# EasyEDA Pro project kuafu01_030内部老化方案.eprj, board PCB4 (continued)
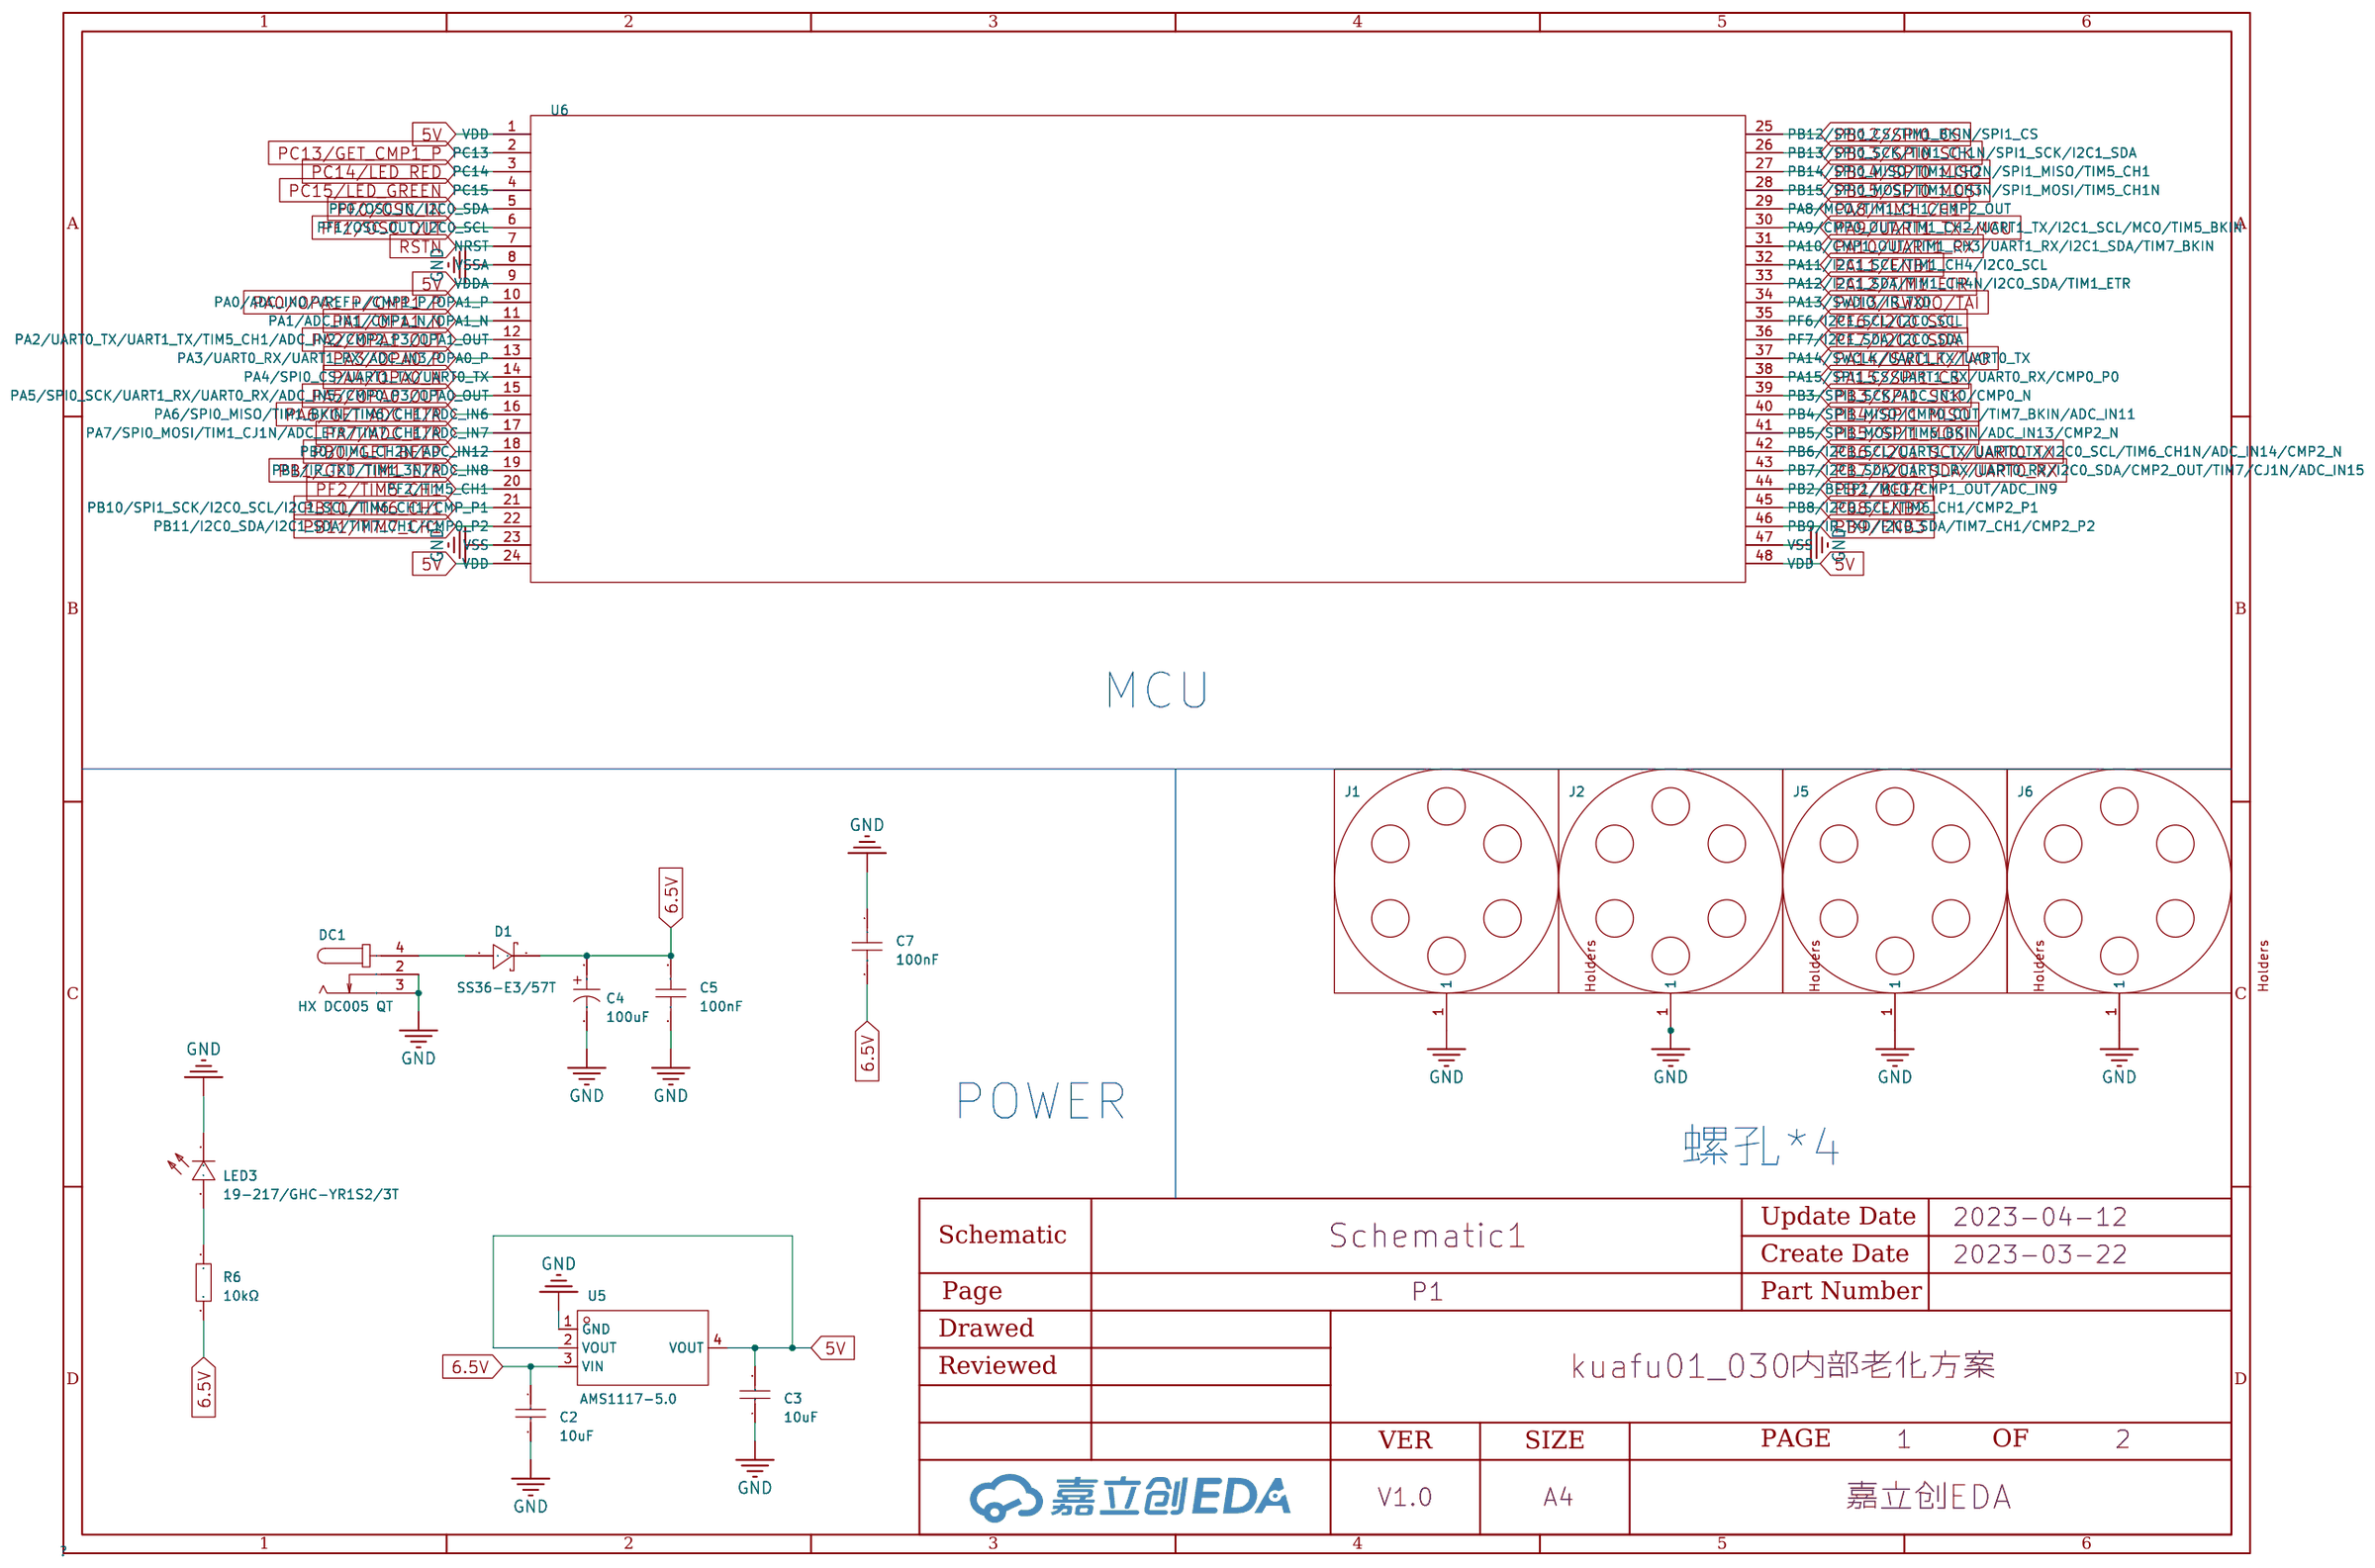
[diagram p0: P1]
## Routing (per net, layer and track width the routed paths; a pad name or vN(x,y) marks a point on that pad's centre or on a via; arc(x,y) is an arc through that point) (continued)
  Top Layer w0.508: 200.44,161.61 200.41,161.58 v1(200.41,157.57) ; 200.44,161.61 149.57,161.61 ; 200.44,161.61 251.35,161.61 ; 236.94,339.07 236.94,339.07 v1(236.94,334.16) ; v1(43.43,270.81) 44.29,271.67 44.29,272.14 ; 149.57,161.61 98.97,161.61 ; 149.57,161.61 149.61,161.57 v1(149.61,157.57) ; 45.29,164.02 44.29,164.02 v1(41.25,167.06) ; 45.29,164.02 v1(47.58,164.02) ; 45.29,164.02 48.16,166.9 48.16,167.38 ; v1(153.07,114.69) 154.26,114.69 156.79,117.22 v1(156.79,118.95) ; 98.97,161.61 48.02,161.61 ; 98.97,161.61 98.81,161.45 v1(98.81,157.57) ; v1(139.01,173.28) 139.01,171.89 ; 139.01,171.89 139.02,171.89 140.14,171.89 ; 139.01,171.89 139.01,166.75 139.72,166.04 140.27,166.04 140.34,166.12 140.34,166.03 v1(140.35,166.01) ; v1(48.01,106.77) 44.55,110.24 34.04,110.24 21.34,122.94 21.34,161.61 ; 299.29,265.62 302.16,268.5 302.16,268.98 ; 299.29,265.62 v1(301.58,265.62) ; 299.29,265.62 298.29,265.62 v1(295.25,268.66) ; 200.12,252.96 195.17,248.01 v1(195.17,239.32) ; v1(145.03,321.61) 145.89,322.47 145.89,322.94 ; 292.54,222.69 291.42,222.69 291.41,222.69 ; 48.01,59.27 v1(48.01,55.97) ; 48.18,313.94 60.96,313.94 64.89,317.88 C3#4.2 64.86,323.25 U5#3.4 ; 48.18,313.94 34.54,313.94 24.38,303.78 24.38,263.17 ; 48.18,313.94 48.01,313.78 v1(48.01,309.97) ; v1(135.34,80.16) 135.34,85.07 135.34,85.07 ; 98.83,366.27 149.6,366.27 ; 98.83,366.27 98.81,366.26 v1(98.81,360.77) ; 98.83,366.27 88.9,366.27 83.82,361.19 83.82,356.01 C3#3.2 ; 149.6,366.27 200.34,366.27 ; 149.6,366.27 149.61,366.26 v1(149.61,360.77) ; 146.89,11.62 145.89,11.62 v1(142.85,14.66) ; 146.89,11.62 v1(149.18,11.62) ; 146.89,11.62 149.76,14.5 149.76,14.98 ; v1(162.06,74.16) 162.06,73.16 162.27,72.96 162.27,70.83 161.73,70.3 157.54,70.3 v1(156.8,71.04) ; 139.01,19.49 139.01,14.35 139.72,13.64 140.27,13.64 140.34,13.72 140.34,13.63 v1(140.35,13.61) ; 139.01,19.49 v1(139.01,20.88) ; 139.01,19.49 139.02,19.49 140.14,19.49 ; v1(200.37,306.12) 200.37,303.86 200.29,303.78 ; 299.29,113.22 302.16,116.1 302.16,116.58 ; 299.29,113.22 298.29,113.22 v1(295.25,116.26) ; 299.29,113.22 v1(301.58,113.22) ; 95.09,18.14 95.09,17.67 v1(94.23,16.81) ; 197.69,316.42 196.69,316.42 v1(193.65,319.46) ; 197.69,316.42 v1(199.98,316.42) ; 197.69,316.42 200.56,319.3 200.56,319.78 ; 45.29,11.62 44.29,11.62 v1(41.25,14.66) ; 45.29,11.62 48.16,14.5 48.16,14.98 ; 45.29,11.62 v1(47.58,11.62) ; v1(55.19,68.15) 55.19,66.42 52.66,63.89 v1(51.47,63.89) ; 197.69,164.02 196.69,164.02 v1(193.65,167.06) ; 197.69,164.02 200.56,166.9 200.56,167.38 ; 197.69,164.02 v1(199.98,164.02) ; 248.49,11.62 251.36,14.5 251.36,14.98 ; 248.49,11.62 247.49,11.62 v1(244.45,14.66) ; 248.49,11.62 v1(250.78,11.62) ; v1(305.47,114.69) 306.66,114.69 309.19,117.22 v1(309.19,118.95) ; 96.09,265.62 98.96,268.5 98.96,268.98 ; 96.09,265.62 95.09,265.62 v1(92.05,268.66) ; 96.09,265.62 v1(98.38,265.62) ; v1(200.41,208.37) 203.88,211.84 251.13,211.84 ; v1(251.21,106.77) 251.21,110.15 251.13,110.24 ; v1(55.2,223.44) 55.94,222.7 60.13,222.7 60.67,223.23 60.67,225.36 60.46,225.56 v1(60.46,226.56) ; v1(105.99,68.15) 105.99,66.42 103.46,63.89 v1(102.27,63.89) ; v1(251.17,356.92) 251.17,354.66 251.09,354.58 ; 190.94,121.09 189.82,121.09 189.81,121.09 ; 44.29,119.74 44.29,119.27 v1(43.43,118.41) ; 186.14,85.07 186.14,85.07 v1(186.14,80.16) ; 88.21,171.89 88.22,171.89 89.34,171.89 ; 88.21,171.89 v1(88.21,173.28) ; 88.21,171.89 88.21,166.75 88.92,166.04 89.47,166.04 89.54,166.12 89.54,166.03 v1(89.55,166.01) ; v1(153.07,63.89) 154.26,63.89 156.79,66.42 v1(156.79,68.15) ; v1(43.43,169.21) 44.29,170.07 44.29,170.54 ; v1(51.47,13.09) 52.66,13.09 55.19,15.62 v1(55.19,17.35) ; 98.52,151.36 93.57,146.41 v1(93.57,137.72) ; v1(47.97,255.32) 47.97,253.06 47.89,252.98 ; 250.92,252.96 245.97,248.01 v1(245.97,239.32) ; 248.49,316.42 251.36,319.3 251.36,319.78 ; 248.49,316.42 247.49,316.42 v1(244.45,319.46) ; 248.49,316.42 v1(250.78,316.42) ; 96.09,214.82 v1(98.38,214.82) ; 96.09,214.82 98.96,217.7 98.96,218.18 ; 96.09,214.82 95.09,214.82 v1(92.05,217.86) ; v1(241.95,115.21) 241.94,115.23 241.94,115.32 241.87,115.24 241.32,115.24 240.61,115.95 240.61,121.09 ; v1(297.43,270.81) 298.29,271.67 298.29,272.14 ; v1(111.26,277.36) 111.26,276.36 111.47,276.16 111.47,274.03 110.93,273.5 106.74,273.5 v1(106,274.24) ; v1(98.81,55.97) 98.81,59.29 ; 298.29,170.54 298.29,170.07 v1(297.43,169.21) ; 250.92,202.16 245.97,197.21 v1(245.97,188.52) ; v1(139.01,274.88) 139.01,273.49 ; 139.01,273.49 139.02,273.49 140.14,273.49 ; 139.01,273.49 139.01,268.36 139.72,267.64 140.27,267.64 140.34,267.72 140.34,267.63 v1(140.35,267.61) ; 146.89,113.22 145.89,113.22 v1(142.85,116.26) ; 146.89,113.22 149.76,116.1 149.76,116.58 ; 146.89,113.22 v1(149.18,113.22) ; v1(251.21,55.97) 251.21,59.43 251.21,59.44 ; 189.81,171.89 189.82,171.89 190.94,171.89 ; 189.81,171.89 189.81,166.75 190.52,166.04 191.07,166.04 191.14,166.12 191.14,166.03 v1(191.15,166.01) ; 189.81,171.89 v1(189.81,173.28) ; v1(191.15,267.61) 191.14,267.63 191.14,267.72 191.07,267.64 190.52,267.64 189.81,268.36 189.81,273.49 ; 88.21,273.49 88.21,268.36 88.92,267.64 89.47,267.64 89.54,267.72 89.54,267.63 v1(89.55,267.61) ; 88.21,273.49 v1(88.21,274.88) ; 88.21,273.49 88.22,273.49 89.34,273.49 ; v1(162.06,226.56) 162.06,225.56 162.27,225.36 162.27,223.23 161.73,222.7 157.54,222.7 v1(156.8,223.44) ; 302.05,313.94 251.27,313.94 ; 302.05,313.94 333.25,313.94 336.8,317.5 336.8,349.5 320.04,366.27 301.89,366.27 ; 302.05,313.94 302.01,313.91 v1(302.01,309.97) ; 251.27,313.94 200.24,313.94 ; 251.27,313.94 251.21,313.89 v1(251.21,309.97) ; 149.71,110.24 102.28,110.24 v1(98.81,106.77) ; 149.71,110.24 200.48,110.24 ; 149.71,110.24 149.61,110.14 v1(149.61,106.77) ; v1(302.01,157.57) 302.01,161.52 302.11,161.61 ; v1(105.99,220.55) 105.99,218.82 103.46,216.29 v1(102.27,216.29) ; v1(162.06,277.36) 162.06,276.36 162.27,276.16 162.27,274.03 161.73,273.5 157.54,273.5 v1(156.8,274.24) ; 146.89,164.02 v1(149.18,164.02) ; 146.89,164.02 149.76,166.9 149.76,167.38 ; 146.89,164.02 145.89,164.02 v1(142.85,167.06) ; 241.74,324.29 240.62,324.29 240.61,324.29 ; 240.61,19.49 240.62,19.49 241.74,19.49 ; 240.61,19.49 240.61,14.35 241.32,13.64 241.87,13.64 241.94,13.72 241.94,13.63 v1(241.95,13.61) ; 240.61,19.49 v1(240.61,20.88) ; v1(42.77,188.52) 42.77,197.21 47.72,202.16 ; 292.54,171.89 291.42,171.89 291.41,171.89 ; 135.34,34.27 135.34,34.27 v1(135.34,29.36) ; 64.89,328 64.86,328.02 U5#3.2 ; v1(111.26,23.36) 111.26,22.36 111.47,22.16 111.47,20.03 110.93,19.5 106.74,19.5 v1(106,20.24) ; 88.21,222.69 88.21,217.56 88.92,216.84 89.47,216.84 89.54,216.92 89.54,216.83 v1(89.55,216.81) ; 88.21,222.69 v1(88.21,224.08) ; 88.21,222.69 88.22,222.69 89.34,222.69 ; 96.09,62.42 98.96,65.3 98.96,65.78 ; 96.09,62.42 95.09,62.42 v1(92.05,65.46) ; 96.09,62.42 v1(98.38,62.42) ; 149.76,319.78 149.76,319.3 146.89,316.42 ; 146.89,265.62 145.89,265.62 v1(142.85,268.66) ; 146.89,265.62 v1(149.18,265.62) ; 146.89,265.62 149.76,268.5 149.76,268.98 ; 197.69,11.62 v1(199.98,11.62) ; 197.69,11.62 196.69,11.62 v1(193.65,14.66) ; 197.69,11.62 200.56,14.5 200.56,14.98 ; v1(251.21,208.37) 251.21,211.75 251.13,211.84 ; 248.49,62.42 251.36,65.3 251.36,65.78 ; 248.49,62.42 v1(250.78,62.42) ; 248.49,62.42 247.49,62.42 v1(244.45,65.46) ; 48.16,218.18 48.16,217.7 45.29,214.82 ; v1(296.77,188.52) 296.77,197.21 301.72,202.16 ; 240.61,70.29 240.61,65.16 241.32,64.44 241.87,64.44 241.94,64.52 241.94,64.43 v1(241.95,64.41) ; 240.61,70.29 v1(240.61,71.68) ; 240.61,70.29 240.62,70.29 241.74,70.29 ; v1(292.75,216.81) 292.74,216.83 292.74,216.92 292.67,216.84 292.12,216.84 291.41,217.56 291.41,222.69 ; 48.08,212.34 33.53,212.34 24.38,221.49 24.38,263.17 ; 48.08,212.34 99.01,212.34 ; 48.08,212.34 48.01,212.28 v1(48.01,208.37) ; 24.38,263.17 48.02,263.17 ; 84.54,186.67 84.54,186.67 v1(84.54,181.76) ; 38.54,19.49 37.42,19.49 37.41,19.49 ; 197.69,113.22 200.56,116.1 200.56,116.58 ; 197.69,113.22 v1(199.98,113.22) ; 197.69,113.22 196.69,113.22 v1(193.65,116.26) ; 302.11,161.61 324.68,161.61 336.8,173.74 336.8,206.76 331.72,211.84 301.91,211.84 ; 302.11,161.61 251.35,161.61 ; v1(200.37,52.12) 200.37,49.86 200.29,49.78 ; v1(37.41,71.68) 37.41,70.29 ; 37.41,70.29 37.42,70.29 38.54,70.29 ; 37.41,70.29 37.41,65.16 38.12,64.44 38.67,64.44 38.74,64.52 38.74,64.43 v1(38.75,64.41) ; 291.41,121.09 291.42,121.09 292.54,121.09 ; 291.41,121.09 v1(291.41,122.48) ; 291.41,121.09 291.41,115.95 292.12,115.24 292.67,115.24 292.74,115.32 292.74,115.23 v1(292.75,115.21) ; v1(258.39,220.55) 258.39,218.82 255.86,216.29 v1(254.67,216.29) ; 98.69,100.58 98.77,100.66 v1(98.77,102.92) ; 98.52,49.76 93.57,44.81 v1(93.57,36.12) ; v1(296.77,290.12) 296.77,298.81 301.72,303.76 ; v1(287.74,232.56) 287.74,237.47 287.74,237.47 ; 149.32,151.36 144.37,146.41 v1(144.37,137.72) ; 139.01,324.29 139.01,319.15 139.72,318.44 140.27,318.44 140.34,318.52 140.34,318.43 v1(140.35,318.41) ; 139.01,324.29 v1(139.01,325.68) ; 139.01,324.29 139.02,324.29 140.14,324.29 ; 299.29,316.42 v1(301.58,316.42) ; 299.29,316.42 302.16,319.3 302.16,319.78 ; 299.29,316.42 298.29,316.42 v1(295.25,319.46) ; 200.56,218.18 200.56,217.7 197.69,214.82 ; 47.89,100.58 47.97,100.66 v1(47.97,102.92) ; 200.24,313.94 149.74,313.94 ; 200.24,313.94 200.41,313.77 v1(200.41,309.97) ; 149.74,313.94 149.61,313.82 v1(149.61,309.97) ; 149.74,313.94 102.79,313.94 v1(98.81,309.97) ; 248.49,265.62 251.36,268.5 251.36,268.98 ; 248.49,265.62 247.49,265.62 v1(244.45,268.66) ; 248.49,265.62 v1(250.78,265.62) ; 33.74,186.67 33.74,186.67 v1(33.74,181.76) ; 145.89,170.54 145.89,170.07 v1(145.03,169.21) ; 189.81,222.69 189.82,222.69 190.94,222.69 ; 189.81,222.69 v1(189.81,224.08) ; 189.81,222.69 189.81,217.56 190.52,216.84 191.07,216.84 191.14,216.92 191.14,216.83 v1(191.15,216.81) ; v1(111.26,175.76) 111.26,174.76 111.47,174.56 111.47,172.43 110.93,171.9 106.74,171.9 v1(106,172.64) ; 200.29,100.58 200.37,100.66 v1(200.37,102.92) ; 37.41,171.89 37.41,166.75 38.12,166.04 38.67,166.04 38.74,166.12 38.74,166.03 v1(38.75,166.01) ; 37.41,171.89 37.42,171.89 38.54,171.89 ; 37.41,171.89 v1(37.41,173.28) ; 291.41,324.29 291.41,319.15 292.12,318.44 292.67,318.44 292.74,318.52 292.74,318.43 v1(292.75,318.41) ; 291.41,324.29 291.42,324.29 292.54,324.29 ; 291.41,324.29 v1(291.41,325.68) ; v1(149.57,204.52) 149.57,202.26 149.49,202.18 ; v1(305.47,267.09) 306.66,267.09 309.19,269.62 v1(309.19,271.35) ; 149.76,65.78 149.76,65.3 146.89,62.42 ; 21.34,161.61 48.02,161.61 ; 21.34,161.61 21.34,304.29 33.02,315.98 49.14,315.98 U5.4 U5.2 ; 48.02,161.61 48.01,161.6 v1(48.01,157.57) ; 89.34,324.29 88.22,324.29 88.21,324.29 ; 200.56,65.78 200.56,65.3 197.69,62.42 ; 287.74,288.27 287.74,288.27 v1(287.74,283.36) ; 45.29,265.62 v1(47.58,265.62) ; 45.29,265.62 44.29,265.62 v1(41.25,268.66) ; 45.29,265.62 48.16,268.5 48.16,268.98 ; 251.36,218.18 251.36,217.7 248.49,214.82 ; v1(297.43,67.61) 298.29,68.47 298.29,68.94 ; v1(60.46,74.16) 60.46,73.16 60.67,72.96 60.67,70.83 60.13,70.3 55.94,70.3 v1(55.2,71.04) ; v1(212.86,328.16) 212.86,327.16 213.07,326.96 213.07,324.83 212.53,324.3 208.34,324.3 v1(207.6,325.04) ; 197.69,62.42 v1(199.98,62.42) ; 197.69,62.42 196.69,62.42 v1(193.65,65.46) ; v1(189.81,122.48) 189.81,121.09 ; 189.81,121.09 189.81,115.95 190.52,115.24 191.07,115.24 191.14,115.32 191.14,115.23 v1(191.15,115.21) ; 186.14,135.87 186.14,135.87 v1(186.14,130.96) ; 301.89,366.27 302.01,366.15 v1(302.01,360.77) ; 301.89,366.27 200.34,366.27 ; 149.76,218.18 149.76,217.7 146.89,214.82 ; v1(212.86,175.76) 212.86,174.76 213.07,174.56 213.07,172.43 212.53,171.9 208.34,171.9 v1(207.6,172.64) ; v1(162.06,124.96) 162.06,123.96 162.27,123.76 162.27,121.63 161.73,121.1 157.54,121.1 v1(156.8,121.84) ; 291.41,222.69 v1(291.41,224.08) ; 45.29,62.42 44.29,62.42 v1(41.25,65.46) ; 45.29,62.42 48.16,65.3 48.16,65.78 ; 45.29,62.42 v1(47.58,62.42) ; 251.12,263.17 298.02,263.17 v1(302.01,259.17) ; 251.12,263.17 251.21,263.08 v1(251.21,259.17) ; 251.12,263.17 200.45,263.17 ; 240.61,273.49 240.61,268.36 241.32,267.64 241.87,267.64 241.94,267.72 241.94,267.63 v1(241.95,267.61) ; 240.61,273.49 v1(240.61,274.88) ; 240.61,273.49 240.62,273.49 241.74,273.49 ; 189.81,324.29 189.82,324.29 190.94,324.29 ; 189.81,324.29 189.81,319.15 190.52,318.44 191.07,318.44 191.14,318.52 191.14,318.43 v1(191.15,318.41) ; 189.81,324.29 v1(189.81,325.68) ; v1(111.26,124.96) 111.26,123.96 111.47,123.76 111.47,121.63 110.93,121.1 106.74,121.1 v1(106,121.84) ; v1(51.47,165.49) 52.66,165.49 55.19,168.02 v1(55.19,169.75) ; v1(156.8,20.24) 157.54,19.5 161.73,19.5 162.27,20.03 162.27,22.16 162.06,22.36 v1(162.06,23.36) ; v1(135.34,283.36) 135.34,288.27 135.34,288.27 ; v1(302.01,106.77) 302.01,110.22 302.03,110.24 ; 301.72,354.56 296.77,349.61 v1(296.77,340.92) ; 37.41,222.69 37.41,217.56 38.12,216.84 38.67,216.84 38.74,216.92 38.74,216.83 v1(38.75,216.81) ; 37.41,222.69 37.42,222.69 38.54,222.69 ; 37.41,222.69 v1(37.41,224.08) ; v1(37.41,274.88) 37.41,273.49 ; 37.41,273.49 37.42,273.49 38.54,273.49 ; 37.41,273.49 37.41,268.36 38.12,267.64 38.67,267.64 38.74,267.72 38.74,267.63 v1(38.75,267.61) ; 248.49,214.82 v1(250.78,214.82) ; 248.49,214.82 247.49,214.82 v1(244.45,217.86) ; v1(55.2,274.24) 55.94,273.5 60.13,273.5 60.67,274.03 60.67,276.16 60.46,276.36 v1(60.46,277.36) ; 135.34,339.07 135.34,339.07 v1(135.34,334.16) ; 145.89,68.94 145.89,68.47 v1(145.03,67.61) ; v1(254.67,317.89) 255.86,317.89 258.39,320.42 v1(258.39,322.15) ; v1(296.77,86.92) 296.77,95.61 301.72,100.56 ; 291.41,70.29 291.41,65.16 292.12,64.44 292.67,64.44 292.74,64.52 292.74,64.43 v1(292.75,64.41) ; 291.41,70.29 291.42,70.29 292.54,70.29 ; 291.41,70.29 v1(291.41,71.68) ; v1(309.19,68.15) 309.19,66.42 306.66,63.89 v1(305.47,63.89) ; v1(149.61,55.97) 149.61,59.29 149.75,59.44 ; v1(41.25,217.86) 44.29,214.82 45.29,214.82 ; 84.54,135.87 84.54,135.87 v1(84.54,130.96) ; v1(156.8,172.64) 157.54,171.9 161.73,171.9 162.27,172.43 162.27,174.56 162.06,174.76 v1(162.06,175.76) ; 135.34,186.67 135.34,186.67 v1(135.34,181.76) ; v1(195.83,321.61) 196.69,322.47 196.69,322.94 ; 48.02,263.17 48.01,263.16 v1(48.01,259.17) ; 48.02,263.17 149.62,263.17 ; v1(149.57,255.32) 149.57,253.06 149.49,252.98 ; 251.35,161.61 251.21,161.48 v1(251.21,157.57) ; v1(195.17,340.92) 195.17,349.61 200.12,354.56 ; 37.41,121.09 37.41,115.95 38.12,115.24 38.67,115.24 38.74,115.32 38.74,115.23 v1(38.75,115.21) ; 37.41,121.09 37.42,121.09 38.54,121.09 ; 37.41,121.09 v1(37.41,122.48) ; v1(212.86,124.96) 212.86,123.96 213.07,123.76 213.07,121.63 212.53,121.1 208.34,121.1 v1(207.6,121.84) ; 33.74,85.07 33.74,85.07 v1(33.74,80.16) ; 88.21,19.49 88.21,14.35 88.92,13.64 89.47,13.64 89.54,13.72 89.54,13.63 v1(89.55,13.61) ; 88.21,19.49 v1(88.21,20.88) ; 88.21,19.49 88.22,19.49 89.34,19.49 ; v1(245.97,36.12) 245.97,44.81 250.92,49.76 ; v1(42.77,137.72) 42.77,146.41 47.72,151.36 ; v1(142.85,217.86) 145.89,214.82 146.89,214.82 ; v1(92.05,319.46) 95.09,316.42 96.09,316.42 ; 248.49,164.02 v1(250.78,164.02) ; 248.49,164.02 247.49,164.02 v1(244.45,167.06) ; 248.49,164.02 251.36,166.9 251.36,167.38 ; 247.49,221.34 247.49,220.87 v1(246.63,220.01) ; v1(207.6,274.24) 208.34,273.5 212.53,273.5 213.07,274.03 213.07,276.16 212.86,276.36 v1(212.86,277.36) ; 146.89,62.42 145.89,62.42 v1(142.85,65.46) ; 146.89,62.42 v1(149.18,62.42) ; 200.34,366.27 200.41,366.2 v1(200.41,360.77) ; 200.12,151.36 195.17,146.41 v1(195.17,137.72) ; v1(263.66,175.76) 263.66,174.76 263.87,174.56 263.87,172.43 263.33,171.9 259.14,171.9 v1(258.4,172.64) ; 299.29,214.82 302.16,217.7 302.16,218.18 ; 299.29,214.82 v1(301.58,214.82) ; 299.29,214.82 298.29,214.82 v1(295.25,217.86) ; 37.41,19.49 37.41,14.35 38.12,13.64 38.67,13.64 38.74,13.72 38.74,13.63 v1(38.75,13.61) ; 37.41,19.49 v1(37.41,20.88) ; v1(309.2,325.04) 309.94,324.3 314.13,324.3 314.67,324.83 314.67,326.96 314.46,327.16 v1(314.46,328.16) ; 146.89,214.82 v1(149.18,214.82) ; 189.81,273.49 189.82,273.49 190.94,273.49 ; 189.81,273.49 v1(189.81,274.88) ; v1(314.46,175.76) 314.46,174.76 314.67,174.56 314.67,172.43 314.13,171.9 309.94,171.9 v1(309.2,172.64) ; 301.72,151.36 296.77,146.41 v1(296.77,137.72) ; 301.89,252.98 301.97,253.06 v1(301.97,255.32) ; 301.72,252.96 296.77,248.01 v1(296.77,239.32) ; 247.49,18.14 247.49,17.67 v1(246.63,16.81) ; v1(106,71.04) 106.74,70.3 110.93,70.3 111.47,70.83 111.47,72.96 111.26,73.16 v1(111.26,74.16) ; v1(186.14,283.36) 186.14,288.27 186.14,288.27 ; v1(195.17,188.52) 195.17,197.21 200.12,202.16 ; v1(236.94,29.36) 236.94,34.27 236.94,34.27 ; v1(245.97,290.12) 245.97,298.81 250.92,303.76 ; v1(207.59,118.95) 207.59,117.22 205.06,114.69 v1(203.87,114.69) ; v1(292.75,166.01) 292.74,166.03 292.74,166.12 292.67,166.04 292.12,166.04 291.41,166.75 291.41,171.89 ; v1(89.55,115.21) 89.54,115.23 89.54,115.32 89.47,115.24 88.92,115.24 88.21,115.95 88.21,121.09 ; 47.89,202.18 47.97,202.26 v1(47.97,204.52) ; v1(47.97,306.12) 47.97,303.86 47.89,303.78 ; 298.29,119.74 298.29,119.27 v1(297.43,118.41) ; 251.21,59.44 200.39,59.44 ; 251.21,59.44 328.17,59.44 336.8,68.07 336.8,106.17 332.74,110.24 302.03,110.24 ; v1(258.4,325.04) 259.14,324.3 263.33,324.3 263.87,324.83 263.87,326.96 263.66,327.16 v1(263.66,328.16) ; v1(200.41,106.77) 200.41,110.16 200.48,110.24 ; v1(258.39,271.35) 258.39,269.62 255.86,267.09 v1(254.67,267.09) ; 98.69,303.78 98.77,303.86 v1(98.77,306.12) ; v1(145.03,270.81) 145.89,271.67 145.89,272.14 ; 189.81,70.29 189.82,70.29 190.94,70.29 ; 189.81,70.29 189.81,65.16 190.52,64.44 191.07,64.44 191.14,64.52 191.14,64.43 v1(191.15,64.41) ; 189.81,70.29 v1(189.81,71.68) ; 149.32,49.76 144.37,44.81 v1(144.37,36.12) ; 240.61,171.89 240.62,171.89 241.74,171.89 ; 240.61,171.89 v1(240.61,173.28) ; 240.61,171.89 240.61,166.75 241.32,166.04 241.87,166.04 241.94,166.12 241.94,166.03 v1(241.95,166.01) ; 33.74,34.27 33.74,34.27 v1(33.74,29.36) ; 149.75,59.44 20.32,59.44 18.8,60.96 18.8,308.96 C3.2 33.52,323.92 U5#4.4 U5#4.2 ; 149.75,59.44 200.39,59.44 ; v1(301.97,306.12) 301.97,303.86 301.89,303.78 ; v1(207.59,271.35) 207.59,269.62 205.06,267.09 v1(203.87,267.09) ; 251.09,100.58 251.17,100.66 v1(251.17,102.92) ; v1(94.23,321.61) 95.09,322.47 95.09,322.94 ; 241.74,222.69 240.62,222.69 240.61,222.69 ; 140.14,121.09 139.02,121.09 139.01,121.09 ; 200.29,252.98 200.37,253.06 v1(200.37,255.32) ; 200.12,100.56 195.17,95.61 v1(195.17,86.92) ; v1(93.57,290.12) 93.57,298.81 98.52,303.76 ; v1(149.61,259.17) 149.61,263.16 149.62,263.17 ; 95.09,272.14 95.09,271.67 v1(94.23,270.81) ; v1(89.55,318.41) 89.54,318.43 89.54,318.52 89.47,318.44 88.92,318.44 88.21,319.15 88.21,324.29 ; v1(207.59,220.55) 207.59,218.82 205.06,216.29 v1(203.87,216.29) ; 247.49,119.74 247.49,119.27 v1(246.63,118.41) ; 248.49,113.22 v1(250.78,113.22) ; 248.49,113.22 247.49,113.22 v1(244.45,116.26) ; 248.49,113.22 251.36,116.1 251.36,116.58 ; 96.09,316.42 98.96,319.3 98.96,319.78 ; 96.09,316.42 v1(98.38,316.42) ; 140.14,222.69 139.02,222.69 139.01,222.69 ; v1(287.74,334.16) 287.74,339.07 287.74,339.07 ; v1(106,223.44) 106.74,222.7 110.93,222.7 111.47,223.23 111.47,225.36 111.26,225.56 v1(111.26,226.56) ; 99.01,212.34 98.81,212.15 v1(98.81,208.37) ; 99.01,212.34 145.64,212.34 v1(149.61,208.37) ; 84.54,85.07 84.54,85.07 v1(84.54,80.16) ; v1(246.63,169.21) 247.49,170.07 247.49,170.54 ; v1(207.6,20.24) 208.34,19.5 212.53,19.5 213.07,20.03 213.07,22.16 212.86,22.36 v1(212.86,23.36) ; v1(245.97,86.92) 245.97,95.61 250.92,100.56 ; v1(263.66,124.96) 263.66,123.96 263.87,123.76 263.87,121.63 263.33,121.1 259.14,121.1 v1(258.4,121.84) ; v1(195.17,36.12) 195.17,44.81 200.12,49.76 ; v1(309.2,71.04) 309.94,70.3 314.13,70.3 314.67,70.83 314.67,72.96 314.46,73.16 v1(314.46,74.16) ; 200.45,263.17 200.41,263.14 v1(200.41,259.17) ; 200.45,263.17 149.62,263.17 ; 200.48,110.24 251.13,110.24 ; 240.61,121.09 240.62,121.09 241.74,121.09 ; 240.61,121.09 v1(240.61,122.48) ; v1(105.99,271.35) 105.99,269.62 103.46,267.09 v1(102.27,267.09) ; v1(153.07,317.89) 154.26,317.89 156.79,320.42 v1(156.79,322.15) ; 145.89,18.14 145.89,17.67 v1(145.03,16.81) ; 33.74,135.87 33.74,135.87 v1(33.74,130.96) ; v1(93.57,188.52) 93.57,197.21 98.52,202.16 ; v1(98.77,255.32) 98.77,253.06 98.69,252.98 ; v1(145.03,118.41) 145.89,119.27 145.89,119.74 ; 186.14,34.27 186.14,34.27 v1(186.14,29.36) ; v1(245.97,137.72) 245.97,146.41 250.92,151.36 ; 88.21,121.09 v1(88.21,122.48) ; 88.21,121.09 88.22,121.09 89.34,121.09 ; v1(145.03,220.01) 145.89,220.87 145.89,221.34 ; v1(102.27,317.89) 103.46,317.89 105.99,320.42 v1(105.99,322.15) ; 98.52,100.56 93.57,95.61 v1(93.57,86.92) ; 149.49,151.38 149.57,151.46 v1(149.57,153.72) ; v1(84.54,334.16) 84.54,339.07 84.54,339.07 ; 45.29,214.82 v1(47.58,214.82) ; v1(251.17,255.32) 251.17,253.06 251.09,252.98 ; 197.69,265.62 200.56,268.5 200.56,268.98 ; 197.69,265.62 v1(199.98,265.62) ; 197.69,265.62 196.69,265.62 v1(193.65,268.66) ; 291.41,273.49 291.42,273.49 292.54,273.49 ; 291.41,273.49 v1(291.41,274.88) ; 291.41,273.49 291.41,268.36 292.12,267.64 292.67,267.64 292.74,267.72 292.74,267.63 v1(292.75,267.61) ; v1(314.46,277.36) 314.46,276.36 314.67,276.16 314.67,274.03 314.13,273.5 309.94,273.5 v1(309.2,274.24) ; v1(111.26,328.16) 111.26,327.16 111.47,326.96 111.47,324.83 110.93,324.3 106.74,324.3 v1(106,325.04) ; v1(140.35,216.81) 140.34,216.83 140.34,216.92 140.27,216.84 139.72,216.84 139.01,217.56 139.01,222.69 ; 189.81,19.49 189.82,19.49 190.94,19.49 ; 189.81,19.49 v1(189.81,20.88) ; 189.81,19.49 189.81,14.35 190.52,13.64 191.07,13.64 191.14,13.72 191.14,13.63 v1(191.15,13.61) ; 139.01,121.09 139.01,115.95 139.72,115.24 140.27,115.24 140.34,115.32 140.34,115.23 v1(140.35,115.21) ; 139.01,121.09 v1(139.01,122.48) ; v1(245.97,340.92) 245.97,349.61 250.92,354.56 ; v1(93.57,340.92) 93.57,349.61 98.52,354.56 ; v1(295.25,167.06) 298.29,164.02 299.29,164.02 ; v1(314.46,226.56) 314.46,225.56 314.67,225.36 314.67,223.23 314.13,222.7 309.94,222.7 v1(309.2,223.44) ; v1(156.8,325.04) 157.54,324.3 161.73,324.3 162.27,324.83 162.27,326.96 162.06,327.16 v1(162.06,328.16) ; 200.12,303.76 195.17,298.81 v1(195.17,290.12) ; 88.21,70.29 88.22,70.29 89.34,70.29 ; 88.21,70.29 v1(88.21,71.68) ; 88.21,70.29 88.21,65.16 88.92,64.44 89.47,64.44 89.54,64.52 89.54,64.43 v1(89.55,64.41) ; v1(305.47,216.29) 306.66,216.29 309.19,218.82 v1(309.19,220.55) ; 44.29,221.34 44.29,220.87 v1(43.43,220.01) ; 135.34,135.87 135.34,135.87 v1(135.34,130.96) ; 139.01,70.29 139.01,65.16 139.72,64.44 140.27,64.44 140.34,64.52 140.34,64.43 v1(140.35,64.41) ; 139.01,70.29 v1(139.01,71.68) ; 139.01,70.29 139.02,70.29 140.14,70.29 ; 251.09,202.18 251.17,202.26 v1(251.17,204.52) ; v1(309.2,121.84) 309.94,121.1 314.13,121.1 314.67,121.63 314.67,123.76 314.46,123.96 v1(314.46,124.96) ; v1(195.83,67.61) 196.69,68.47 196.69,68.94 ; v1(43.43,16.81) 44.29,17.67 44.29,18.14 ; v1(291.41,173.28) 291.41,171.89 ; 33.74,237.47 33.74,237.47 v1(33.74,232.56) ; 301.89,354.58 301.97,354.66 v1(301.97,356.92) ; v1(258.39,68.15) 258.39,66.42 255.86,63.89 v1(254.67,63.89) ; 149.32,354.56 144.37,349.61 v1(144.37,340.92) ; v1(258.39,169.75) 258.39,168.02 255.86,165.49 v1(254.67,165.49) ; v1(200.37,204.52) 200.37,202.26 200.29,202.18 ; v1(309.19,169.75) 309.19,168.02 306.66,165.49 v1(305.47,165.49) ; 196.69,18.14 196.69,17.67 v1(195.83,16.81) ; v1(236.94,232.56) 236.94,237.47 236.94,237.47 ; v1(254.67,13.09) 255.86,13.09 258.39,15.62 v1(258.39,17.35) ; v1(92.05,167.06) 95.09,164.02 96.09,164.02 ; v1(251.17,306.12) 251.17,303.86 251.09,303.78 ; 149.32,202.16 144.37,197.21 v1(144.37,188.52) ; v1(258.4,20.24) 259.14,19.5 263.33,19.5 263.87,20.03 263.87,22.16 263.66,22.36 v1(263.66,23.36) ; v1(84.54,232.56) 84.54,237.47 84.54,237.47 ; v1(236.94,181.76) 236.94,186.67 236.94,186.67 ; v1(84.54,283.36) 84.54,288.27 84.54,288.27 ; v1(258.4,71.04) 259.14,70.3 263.33,70.3 263.87,70.83 263.87,72.96 263.66,73.16 v1(263.66,74.16) ; 98.52,252.96 93.57,248.01 v1(93.57,239.32) ; v1(251.17,52.12) 251.17,49.86 251.09,49.78 ; 236.94,288.27 236.94,288.27 v1(236.94,283.36) ; v1(263.66,277.36) 263.66,276.36 263.87,276.16 263.87,274.03 263.33,273.5 259.14,273.5 v1(258.4,274.24) ; 302.03,110.24 251.13,110.24 ; v1(153.07,216.29) 154.26,216.29 156.79,218.82 v1(156.79,220.55) ; v1(195.83,270.81) 196.69,271.67 196.69,272.14 ; 47.89,151.38 47.97,151.46 v1(47.97,153.72) ; 299.29,164.02 302.16,166.9 302.16,167.38 ; 299.29,164.02 v1(301.58,164.02) ; v1(51.47,114.69) 52.66,114.69 55.19,117.22 v1(55.19,118.95) ; v1(156.79,271.35) 156.79,269.62 154.26,267.09 v1(153.07,267.09) ; v1(92.05,116.26) 95.09,113.22 96.09,113.22 ; v1(98.77,204.52) 98.77,202.26 98.69,202.18 ; v1(207.59,17.35) 207.59,15.62 205.06,13.09 v1(203.87,13.09) ; v1(301.97,153.72) 301.97,151.46 301.89,151.38 ; 287.74,85.07 287.74,85.07 v1(287.74,80.16) ; 149.32,252.96 144.37,248.01 v1(144.37,239.32) ; v1(207.6,71.04) 208.34,70.3 212.53,70.3 213.07,70.83 213.07,72.96 212.86,73.16 v1(212.86,74.16) ; v1(142.85,319.46) 145.89,316.42 146.89,316.42 ; 200.29,354.58 200.37,354.66 v1(200.37,356.92) ; v1(251.17,153.72) 251.17,151.46 251.09,151.38 ; v1(241.95,318.41) 241.94,318.43 241.94,318.52 241.87,318.44 241.32,318.44 240.61,319.15 240.61,324.29 ; 95.09,170.54 95.09,170.07 v1(94.23,169.21) ; v1(246.63,270.81) 247.49,271.67 247.49,272.14 ; 146.89,316.42 v1(149.18,316.42) ; 298.29,322.94 298.29,322.47 v1(297.43,321.61) ; 98.96,14.98 98.96,14.5 96.09,11.62 ; 88.21,324.29 v1(88.21,325.68) ; 135.34,237.47 135.34,237.47 v1(135.34,232.56) ; v1(263.66,226.56) 263.66,225.56 263.87,225.36 263.87,223.23 263.33,222.7 259.14,222.7 v1(258.4,223.44) ; v1(42.77,290.12) 42.77,298.81 47.72,303.76 ; v1(240.61,325.68) 240.61,324.29 ; 95.09,221.34 95.09,220.87 v1(94.23,220.01) ; v1(203.87,165.49) 205.06,165.49 207.59,168.02 v1(207.59,169.75) ; 200.39,59.44 200.41,59.41 v1(200.41,55.97) ; v1(203.87,63.89) 205.06,63.89 207.59,66.42 v1(207.59,68.15) ; v1(98.81,259.17) 98.81,262.89 ; 44.29,68.94 44.29,68.47 v1(43.43,67.61) ; v1(33.74,283.36) 33.74,288.27 33.74,288.27 ; 251.13,211.84 301.91,211.84 ; 139.01,222.69 v1(139.01,224.08) ; 196.69,170.54 196.69,170.07 v1(195.83,169.21) ; v1(153.07,13.09) 154.26,13.09 156.79,15.62 v1(156.79,17.35) ; v1(60.46,23.36) 60.46,22.36 60.67,22.16 60.67,20.03 60.13,19.5 55.94,19.5 v1(55.2,20.24) ; v1(47.97,52.12) 47.97,49.86 47.89,49.78 ; v1(297.43,220.01) 298.29,220.87 298.29,221.34 ; 149.49,100.58 149.57,100.66 v1(149.57,102.92) ; v1(102.27,165.49) 103.46,165.49 105.99,168.02 v1(105.99,169.75) ; 301.91,211.84 302.01,211.73 v1(302.01,208.37) ; 301.89,202.18 301.97,202.26 v1(301.97,204.52) ; v1(241.95,216.81) 241.94,216.83 241.94,216.92 241.87,216.84 241.32,216.84 240.61,217.56 240.61,222.69 ; v1(287.74,130.96) 287.74,135.87 287.74,135.87 ; v1(153.07,165.49) 154.26,165.49 156.79,168.02 v1(156.79,169.75) ; v1(98.77,52.12) 98.77,49.86 98.69,49.78 ; v1(200.37,153.72) 200.37,151.46 200.29,151.38 ; v1(144.37,290.12) 144.37,298.81 149.32,303.76 ; v1(212.86,226.56) 212.86,225.56 213.07,225.36 213.07,223.23 212.53,222.7 208.34,222.7 v1(207.6,223.44) ; 47.72,100.56 42.77,95.61 v1(42.77,86.92) ; v1(254.67,114.69) 255.86,114.69 258.39,117.22 v1(258.39,118.95) ; 149.49,303.78 149.57,303.86 v1(149.57,306.12) ; v1(246.63,321.61) 247.49,322.47 247.49,322.94 ; 149.49,49.78 149.57,49.86 v1(149.57,52.12) ; v1(94.23,67.61) 95.09,68.47 95.09,68.94 ; v1(60.46,175.76) 60.46,174.76 60.67,174.56 60.67,172.43 60.13,171.9 55.94,171.9 v1(55.2,172.64) ; 186.14,186.67 186.14,186.67 v1(186.14,181.76) ; 95.09,119.74 95.09,119.27 v1(94.23,118.41) ; 47.72,252.96 42.77,248.01 v1(42.77,239.32) ; v1(295.25,65.46) 298.29,62.42 299.29,62.42 ; 299.29,62.42 v1(301.58,62.42) ; 299.29,62.42 302.16,65.3 302.16,65.78 ; v1(42.77,36.12) 42.77,44.81 47.72,49.76 ; v1(186.14,334.16) 186.14,339.07 186.14,339.07 ; 197.69,214.82 v1(199.98,214.82) ; 197.69,214.82 196.69,214.82 v1(193.65,217.86) ; 149.49,354.58 149.57,354.66 v1(149.57,356.92) ; 247.49,68.94 247.49,68.47 v1(246.63,67.61) ; v1(41.25,116.26) 44.29,113.22 45.29,113.22 ; v1(236.94,130.96) 236.94,135.87 236.94,135.87 ; 96.09,164.02 98.96,166.9 98.96,167.38 ; 96.09,164.02 v1(98.38,164.02) ; v1(102.27,13.09) 103.46,13.09 105.99,15.62 v1(105.99,17.35) ; v1(240.61,224.08) 240.61,222.69 ; 48.16,116.58 48.16,116.1 45.29,113.22 ; v1(92.05,14.66) 95.09,11.62 96.09,11.62 ; v1(309.19,322.15) 309.19,320.42 306.66,317.89 v1(305.47,317.89) ; 96.09,11.62 v1(98.38,11.62) ; 196.69,221.34 196.69,220.87 v1(195.83,220.01) ; v1(203.87,317.89) 205.06,317.89 207.59,320.42 v1(207.59,322.15) ; 149.32,100.56 144.37,95.61 v1(144.37,86.92) ; v1(287.74,181.76) 287.74,186.67 287.74,186.67 ; 45.29,113.22 v1(47.58,113.22) ; 301.89,100.58 301.97,100.66 v1(301.97,102.92) ; 196.69,119.74 196.69,119.27 v1(195.83,118.41) ; v1(55.2,121.84) 55.94,121.1 60.13,121.1 60.67,121.63 60.67,123.76 60.46,123.96 v1(60.46,124.96) ; v1(236.94,80.16) 236.94,85.07 236.94,85.07 ; 65.99,356.05 66.14,356.05 66.16,356.07 76.4,356.07 76.51,356.18 ; v1(51.47,267.09) 52.66,267.09 55.19,269.62 v1(55.19,271.35) ; v1(51.47,216.29) 52.66,216.29 55.19,218.82 v1(55.19,220.55) ; v1(186.14,232.56) 186.14,237.47 186.14,237.47 ; 96.09,113.22 98.96,116.1 98.96,116.58 ; 96.09,113.22 v1(98.38,113.22) ; v1(105.99,118.95) 105.99,117.22 103.46,114.69 v1(102.27,114.69) ; v1(98.77,356.92) 98.77,354.66 98.69,354.58 ; v1(84.54,29.36) 84.54,34.27 84.54,34.27 ; v1(251.21,360.77) 251.21,366.27 ; v1(98.77,153.72) 98.77,151.46 98.69,151.38